# Altium schematic sheet fpga.SchDoc (part 2 of 3)
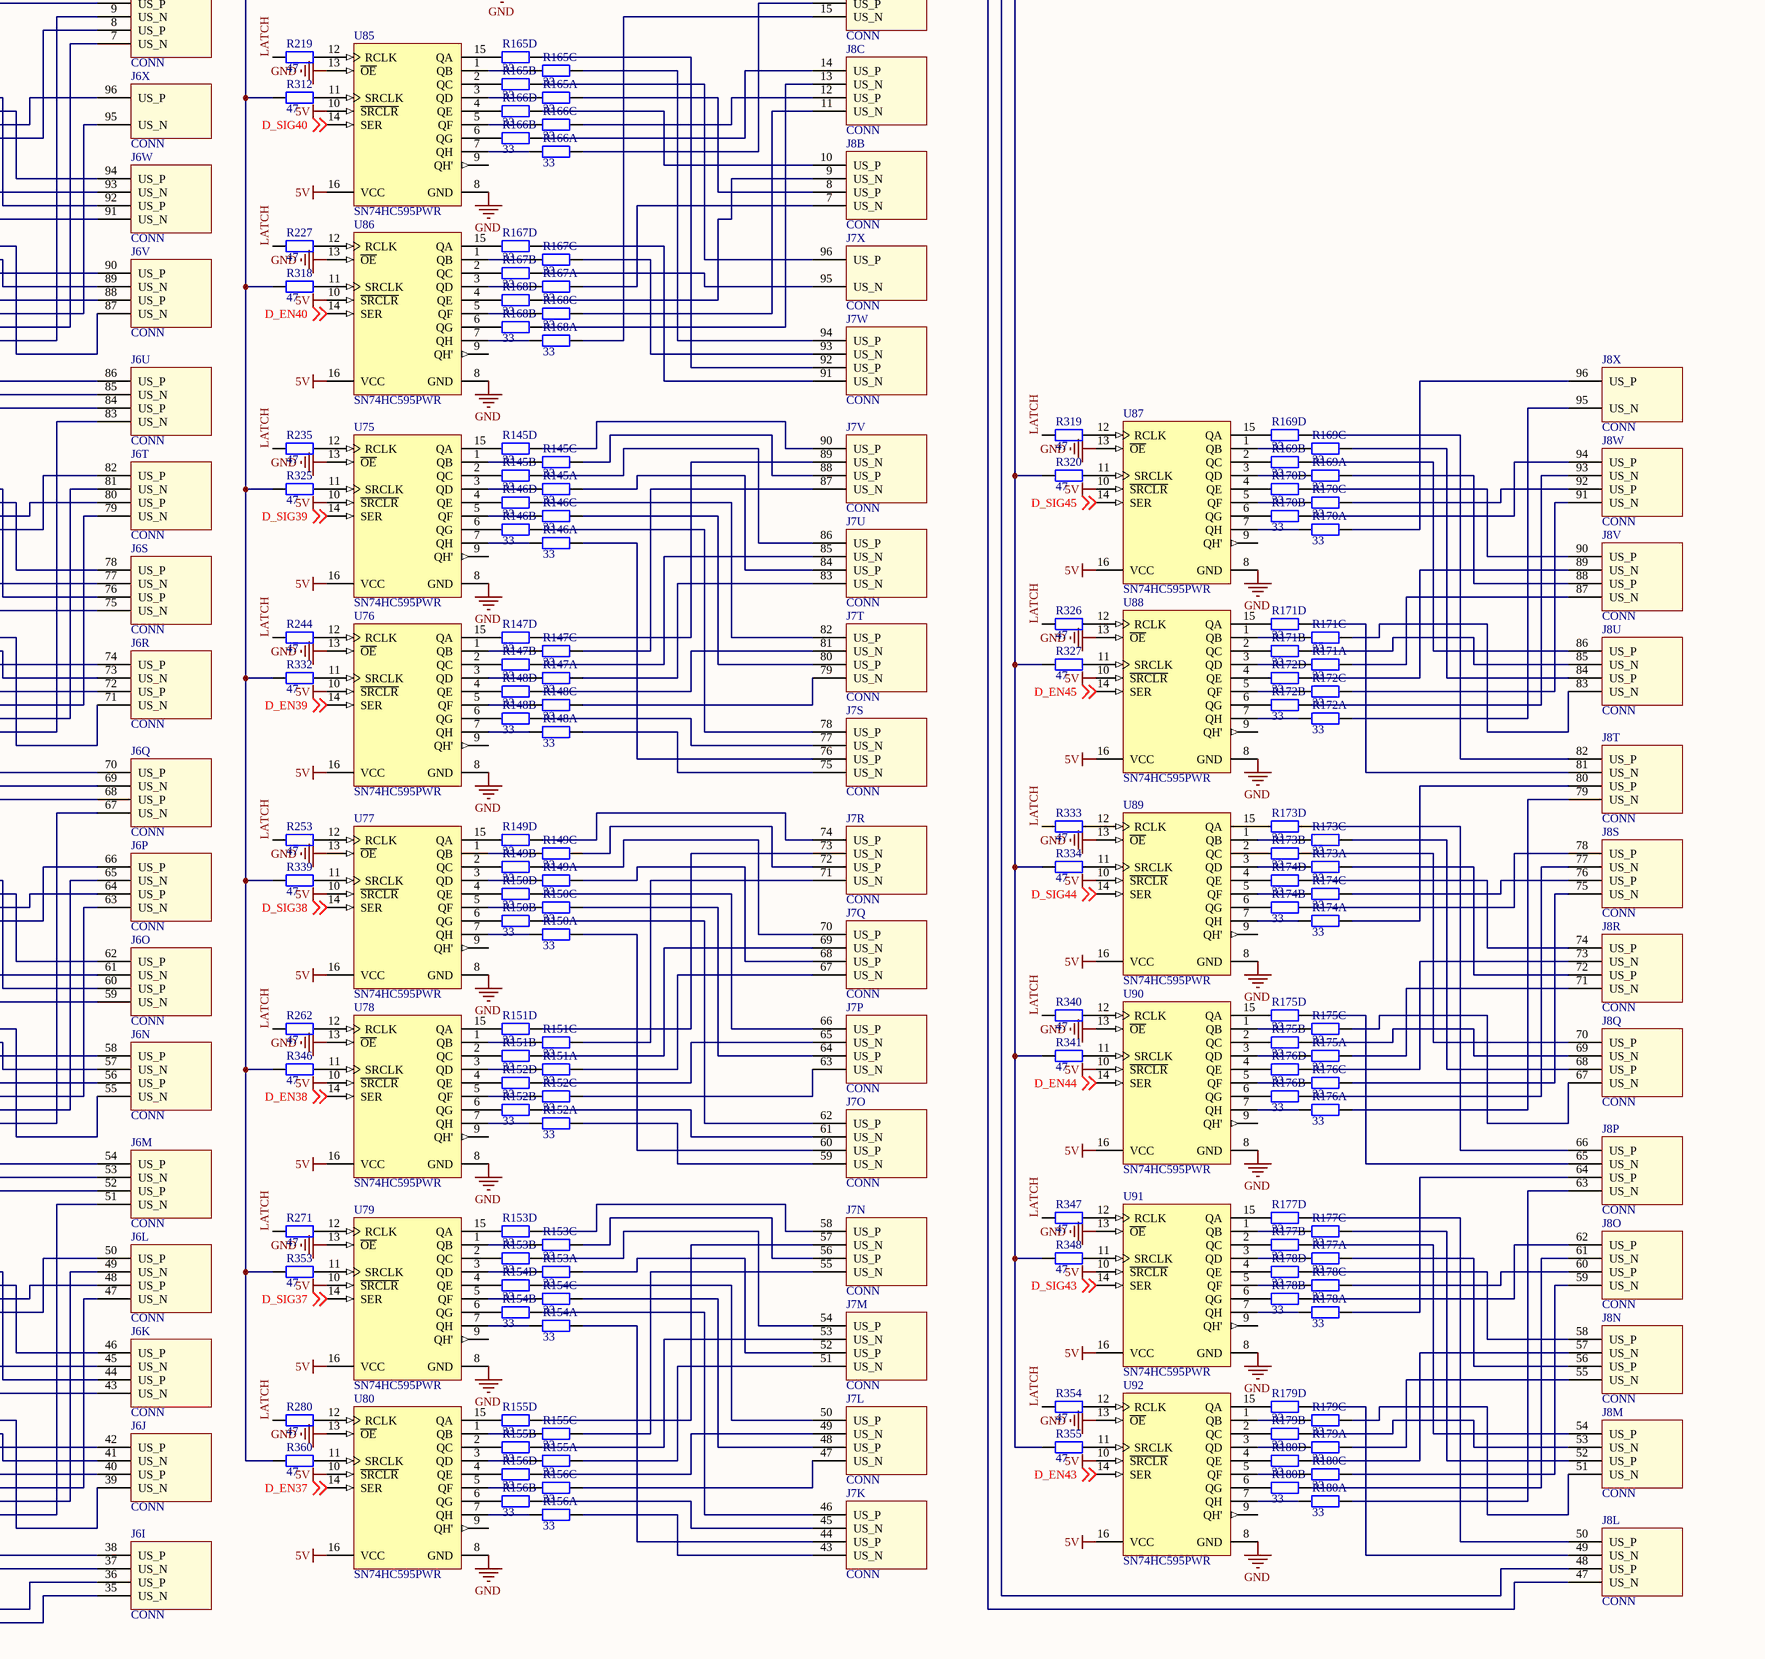
[diagram p6: fpga.SchDoc, bottom right]
## Nets
5V: C1.2 C2.2 C3.2 C4.2 C5.2 C6.2 C7.2 C8.2 C9.2 C10.2 C11.2 C12.2 C13.2 C14.2 C15.2 C16.2 C17.2 C18.2 C19.2 C20.2 C21.2 C22.2 C23.2 C24.2 C25.2 C26.2 C27.2 C28.2 C29.2 C30.2 C31.2 C32.2 C33.2 C34.2 C35.2 C36.2 C37.2 C38.2 C39.2 C40.2 C41.2 C42.2 C43.2 C44.2 C45.2 C46.2 C47.2 C48.2 C49.2 C50.2 C51.2 C52.2 C53.2 C54.2 C55.2 C56.2 C57.2 C58.2 C59.2 C60.2 C61.2 C62.2 C63.2 C64.2 C65.2 C66.2 C67.2 C68.2 C69.2 C70.2 C71.2 C72.2 C73.2 C74.2 C75.2 C76.2 C77.2 C78.2 C79.2 C80.2 C81.2 C82.2 C83.2 C84.2 C85.2 C86.2 C87.2 C88.2 C89.2 C90.2 J1.5(5V) J1.6(3V3) J2.5(5V) J2.6(3V3) J3.5(5V) J3.6(3V3) J4.5(5V) J4.6(3V3) J5.5(5V) J5.6(3V3) J6.5(5V) J6.6(3V3) J7.5(5V) J7.6(3V3) J8.5(5V) J8.6(3V3) U1.10(~{SRCLR}) U1.16(VCC) U2.10(~{SRCLR}) U2.16(VCC) U3.10(~{SRCLR}) U3.16(VCC) U4.10(~{SRCLR}) U4.16(VCC) U5.10(~{SRCLR}) U5.16(VCC) U6.10(~{SRCLR}) U6.16(VCC) U7.10(~{SRCLR}) U7.16(VCC) U8.10(~{SRCLR}) U8.16(VCC) U9.10(~{SRCLR}) U9.16(VCC) U10.10(~{SRCLR}) U10.16(VCC) U11.10(~{SRCLR}) U11.16(VCC) U12.10(~{SRCLR}) U12.16(VCC) U13.10(~{SRCLR}) U13.16(VCC) U14.10(~{SRCLR}) U14.16(VCC) U15.10(~{SRCLR}) U15.16(VCC) U16.10(~{SRCLR}) U16.16(VCC) U17.10(~{SRCLR}) U17.16(VCC) U18.10(~{SRCLR}) U18.16(VCC) U19.10(~{SRCLR}) U19.16(VCC) U20.10(~{SRCLR}) U20.16(VCC) U21.10(~{SRCLR}) U21.16(VCC) U22.10(~{SRCLR}) U22.16(VCC) U23.10(~{SRCLR}) U23.16(VCC) U24.10(~{SRCLR}) U24.16(VCC) U27.10(~{SRCLR}) U27.16(VCC) U28.10(~{SRCLR}) U28.16(VCC) U29.10(~{SRCLR}) U29.16(VCC) U30.10(~{SRCLR}) U30.16(VCC) U31.10(~{SRCLR}) U31.16(VCC) U32.10(~{SRCLR}) U32.16(VCC) U33.10(~{SRCLR}) U33.16(VCC) U34.10(~{SRCLR}) U34.16(VCC) U35.10(~{SRCLR}) U35.16(VCC) U36.10(~{SRCLR}) U36.16(VCC) U37.10(~{SRCLR}) U37.16(VCC) U38.10(~{SRCLR}) U38.16(VCC) U39.10(~{SRCLR}) U39.16(VCC) U40.10(~{SRCLR}) U40.16(VCC) U41.10(~{SRCLR}) U41.16(VCC) U42.10(~{SRCLR}) U42.16(VCC) U43.10(~{SRCLR}) U43.16(VCC) U44.10(~{SRCLR}) U44.16(VCC) U45.10(~{SRCLR}) U45.16(VCC) U46.10(~{SRCLR}) U46.16(VCC) U47.10(~{SRCLR}) U47.16(VCC) U48.10(~{SRCLR}) U48.16(VCC) U49.10(~{SRCLR}) U49.16(VCC) U50.10(~{SRCLR}) U50.16(VCC) U51.10(~{SRCLR}) U51.16(VCC) U52.10(~{SRCLR}) U52.16(VCC) U53.10(~{SRCLR}) U53.16(VCC) U54.10(~{SRCLR}) U54.16(VCC) U55.10(~{SRCLR}) U55.16(VCC) U56.10(~{SRCLR}) U56.16(VCC) U57.10(~{SRCLR}) U57.16(VCC) U58.10(~{SRCLR}) U58.16(VCC) U59.10(~{SRCLR}) U59.16(VCC) U60.10(~{SRCLR}) U60.16(VCC) U61.10(~{SRCLR}) U61.16(VCC) U62.10(~{SRCLR}) U62.16(VCC) U63.10(~{SRCLR}) U63.16(VCC) U64.10(~{SRCLR}) U64.16(VCC) U65.10(~{SRCLR}) U65.16(VCC) U66.10(~{SRCLR}) U66.16(VCC) U67.10(~{SRCLR}) U67.16(VCC) U68.10(~{SRCLR}) U68.16(VCC) U69.10(~{SRCLR}) U69.16(VCC) U70.10(~{SRCLR}) U70.16(VCC) U71.10(~{SRCLR}) U71.16(VCC) U72.10(~{SRCLR}) U72.16(VCC) U73.10(~{SRCLR}) U73.16(VCC) U74.10(~{SRCLR}) U74.16(VCC) U75.10(~{SRCLR}) U75.16(VCC) U76.10(~{SRCLR}) U76.16(VCC) U77.10(~{SRCLR}) U77.16(VCC) U78.10(~{SRCLR}) U78.16(VCC) U79.10(~{SRCLR}) U79.16(VCC) U80.10(~{SRCLR}) U80.16(VCC) U81.10(~{SRCLR}) U81.16(VCC) U82.10(~{SRCLR}) U82.16(VCC) U83.10(~{SRCLR}) U83.16(VCC) U84.10(~{SRCLR}) U84.16(VCC) U85.10(~{SRCLR}) U85.16(VCC) U86.10(~{SRCLR}) U86.16(VCC) U87.10(~{SRCLR}) U87.16(VCC) U88.10(~{SRCLR}) U88.16(VCC) U89.10(~{SRCLR}) U89.16(VCC) U90.10(~{SRCLR}) U90.16(VCC) U91.10(~{SRCLR}) U91.16(VCC) U92.10(~{SRCLR}) U92.16(VCC)
GND: C1.1 C2.1 C3.1 C4.1 C5.1 C6.1 C7.1 C8.1 C9.1 C10.1 C11.1 C12.1 C13.1 C14.1 C15.1 C16.1 C17.1 C18.1 C19.1 C20.1 C21.1 C22.1 C23.1 C24.1 C25.1 C26.1 C27.1 C28.1 C29.1 C30.1 C31.1 C32.1 C33.1 C34.1 C35.1 C36.1 C37.1 C38.1 C39.1 C40.1 C41.1 C42.1 C43.1 C44.1 C45.1 C46.1 C47.1 C48.1 C49.1 C50.1 C51.1 C52.1 C53.1 C54.1 C55.1 C56.1 C57.1 C58.1 C59.1 C60.1 C61.1 C62.1 C63.1 C64.1 C65.1 C66.1 C67.1 C68.1 C69.1 C70.1 C71.1 C72.1 C73.1 C74.1 C75.1 C76.1 C77.1 C78.1 C79.1 C80.1 C81.1 C82.1 C83.1 C84.1 C85.1 C86.1 C87.1 C88.1 C89.1 C90.1 C91.1 C92.1 C93.1 C94.1 C95.1 C96.1 C97.1 C98.1 J1.3(GND) J1.4(GND) J1.97(GND) J1.98(GND) J2.3(GND) J2.4(GND) J2.97(GND) J2.98(GND) J3.3(GND) J3.4(GND) J3.97(GND) J3.98(GND) J4.3(GND) J4.4(GND) J4.97(GND) J4.98(GND) J5.3(GND) J5.4(GND) J5.97(GND) J5.98(GND) J6.3(GND) J6.4(GND) J6.97(GND) J6.98(GND) J7.3(GND) J7.4(GND) J7.97(GND) J7.98(GND) J8.3(GND) J8.4(GND) J8.97(GND) J8.98(GND) U1.8(GND) U1.13(~{OE}) U2.8(GND) U2.13(~{OE}) U3.8(GND) U3.13(~{OE}) U4.8(GND) U4.13(~{OE}) U5.8(GND) U5.13(~{OE}) U6.8(GND) U6.13(~{OE}) U7.8(GND) U7.13(~{OE}) U8.8(GND) U8.13(~{OE}) U9.8(GND) U9.13(~{OE}) U10.8(GND) U10.13(~{OE}) U11.8(GND) U11.13(~{OE}) U12.8(GND) U12.13(~{OE}) U13.8(GND) U13.13(~{OE}) U14.8(GND) U14.13(~{OE}) U15.8(GND) U15.13(~{OE}) U16.8(GND) U16.13(~{OE}) U17.8(GND) U17.13(~{OE}) U18.8(GND) U18.13(~{OE}) U19.8(GND) U19.13(~{OE}) U20.8(GND) U20.13(~{OE}) U21.8(GND) U21.13(~{OE}) U22.8(GND) U22.13(~{OE}) U23.8(GND) U23.13(~{OE}) U24.8(GND) U24.13(~{OE}) U27.8(GND) U27.13(~{OE}) U28.8(GND) U28.13(~{OE}) U29.8(GND) U29.13(~{OE}) U30.8(GND) U30.13(~{OE}) U31.8(GND) U31.13(~{OE}) U32.8(GND) U32.13(~{OE}) U33.8(GND) U33.13(~{OE}) U34.8(GND) U34.13(~{OE}) U35.8(GND) U35.13(~{OE}) U36.8(GND) U36.13(~{OE}) U37.8(GND) U37.13(~{OE}) U38.8(GND) U38.13(~{OE}) U39.8(GND) U39.13(~{OE}) U40.8(GND) U40.13(~{OE}) U41.8(GND) U41.13(~{OE}) U42.8(GND) U42.13(~{OE}) U43.8(GND) U43.13(~{OE}) U44.8(GND) U44.13(~{OE}) U45.8(GND) U45.13(~{OE}) U46.8(GND) U46.13(~{OE}) U47.8(GND) U47.13(~{OE}) U48.8(GND) U48.13(~{OE}) U49.8(GND) U49.13(~{OE}) U50.8(GND) U50.13(~{OE}) U51.8(GND) U51.13(~{OE}) U52.8(GND) U52.13(~{OE}) U53.8(GND) U53.13(~{OE}) U54.8(GND) U54.13(~{OE}) U55.8(GND) U55.13(~{OE}) U56.8(GND) U56.13(~{OE}) U57.8(GND) U57.13(~{OE}) U58.8(GND) U58.13(~{OE}) U59.8(GND) U59.13(~{OE}) U60.8(GND) U60.13(~{OE}) U61.8(GND) U61.13(~{OE}) U62.8(GND) U62.13(~{OE}) U63.8(GND) U63.13(~{OE}) U64.8(GND) U64.13(~{OE}) U65.8(GND) U65.13(~{OE}) U66.8(GND) U66.13(~{OE}) U67.8(GND) U67.13(~{OE}) U68.8(GND) U68.13(~{OE}) U69.8(GND) U69.13(~{OE}) U70.8(GND) U70.13(~{OE}) U71.8(GND) U71.13(~{OE}) U72.8(GND) U72.13(~{OE}) U73.8(GND) U73.13(~{OE}) U74.8(GND) U74.13(~{OE}) U75.8(GND) U75.13(~{OE}) U76.8(GND) U76.13(~{OE}) U77.8(GND) U77.13(~{OE}) U78.8(GND) U78.13(~{OE}) U79.8(GND) U79.13(~{OE}) U80.8(GND) U80.13(~{OE}) U81.8(GND) U81.13(~{OE}) U82.8(GND) U82.13(~{OE}) U83.8(GND) U83.13(~{OE}) U84.8(GND) U84.13(~{OE}) U85.8(GND) U85.13(~{OE}) U86.8(GND) U86.13(~{OE}) U87.8(GND) U87.13(~{OE}) U88.8(GND) U88.13(~{OE}) U89.8(GND) U89.13(~{OE}) U90.8(GND) U90.13(~{OE}) U91.8(GND) U91.13(~{OE}) U92.8(GND) U92.13(~{OE})
VUS: C91.2 C92.2 C93.2 C94.2 C95.2 C96.2 C97.2 C98.2 J1.1(VUS) J1.2(VUS) J1.99(VUS) J1.100(VUS) J2.1(VUS) J2.2(VUS) J2.99(VUS) J2.100(VUS) J3.1(VUS) J3.2(VUS) J3.99(VUS) J3.100(VUS) J4.1(VUS) J4.2(VUS) J4.99(VUS) J4.100(VUS) J5.1(VUS) J5.2(VUS) J5.99(VUS) J5.100(VUS) J6.1(VUS) J6.2(VUS) J6.99(VUS) J6.100(VUS) J7.1(VUS) J7.2(VUS) J7.99(VUS) J7.100(VUS) J8.1(VUS) J8.2(VUS) J8.99(VUS) J8.100(VUS)
CLK1: R212.1 R220.1 R228.1 R236.1 R245.1 R254.1 R263.1 R272.1 R281.1 ; off-sheet CLK1
CLK2: R188.1 R196.1 R204.1 R237.1 R246.1 R255.1 R264.1 R273.1 R282.1 ; off-sheet CLK2
CLK3: R285.1 R291.1 R297.1 R303.1 R307.1 R313.1 R342.1 R349.1 R356.1 ; off-sheet CLK3
CLK4: R286.1 R292.1 R298.1 R304.1 R308.1 R314.1 R321.1 R328.1 R335.1 ; off-sheet CLK4
CLK5: R305.1 R309.1 R315.1 R322.1 R329.1 R336.1 R343.1 R350.1 R357.1 ; off-sheet CLK5
CLK6: R287.1 R293.1 R299.1 R323.1 R330.1 R337.1 R344.1 R351.1 R358.1 ; off-sheet CLK6
CLK7: R288.1 R294.1 R300.1 R306.1 R310.1 R316.1 R345.1 R352.1 R359.1 ; off-sheet CLK7
CLK8: R283.1 R289.1 R295.1 R301.1 R311.1 R317.1 R324.1 R331.1 R338.1 ; off-sheet CLK8
CLK9: R302.1 R312.1 R318.1 R325.1 R332.1 R339.1 R346.1 R353.1 R360.1 ; off-sheet CLK9
CLK10: R284.1 R290.1 R296.1 R320.1 R327.1 R334.1 R341.1 R348.1 R355.1 ; off-sheet CLK10
D_EN1: U23.14(SER) ; off-sheet D_EN1
D_EN2: U19.14(SER) ; off-sheet D_EN2
D_EN3: U15.14(SER) ; off-sheet D_EN3
D_EN4: U11.14(SER) ; off-sheet D_EN4
D_EN5: U7.14(SER) ; off-sheet D_EN5
D_EN6: U3.14(SER) ; off-sheet D_EN6
D_EN7: U24.14(SER) ; off-sheet D_EN7
D_EN8: U20.14(SER) ; off-sheet D_EN8
D_EN9: U16.14(SER) ; off-sheet D_EN9
D_EN10: U12.14(SER) ; off-sheet D_EN10
D_EN11: U8.14(SER) ; off-sheet D_EN11
D_EN12: U4.14(SER) ; off-sheet D_EN12
D_EN13: U38.14(SER) ; off-sheet D_EN13
D_EN14: U36.14(SER) ; off-sheet D_EN14
D_EN15: U34.14(SER) ; off-sheet D_EN15
D_EN16: U32.14(SER) ; off-sheet D_EN16
D_EN17: U30.14(SER) ; off-sheet D_EN17
D_EN18: U28.14(SER) ; off-sheet D_EN18
D_EN19: U50.14(SER) ; off-sheet D_EN19
D_EN20: U48.14(SER) ; off-sheet D_EN20
D_EN21: U46.14(SER) ; off-sheet D_EN21
D_EN22: U44.14(SER) ; off-sheet D_EN22
D_EN23: U42.14(SER) ; off-sheet D_EN23
D_EN24: U40.14(SER) ; off-sheet D_EN24
D_EN25: U62.14(SER) ; off-sheet D_EN25
D_EN26: U60.14(SER) ; off-sheet D_EN26
D_EN27: U58.14(SER) ; off-sheet D_EN27
D_EN28: U56.14(SER) ; off-sheet D_EN28
D_EN29: U54.14(SER) ; off-sheet D_EN29
D_EN30: U52.14(SER) ; off-sheet D_EN30
D_EN31: U70.14(SER) ; off-sheet D_EN31
D_EN32: U68.14(SER) ; off-sheet D_EN32
D_EN33: U66.14(SER) ; off-sheet D_EN33
D_EN34: U64.14(SER) ; off-sheet D_EN34
D_EN35: U74.14(SER) ; off-sheet D_EN35
D_EN36: U72.14(SER) ; off-sheet D_EN36
D_EN37: U80.14(SER) ; off-sheet D_EN37
D_EN38: U78.14(SER) ; off-sheet D_EN38
D_EN39: U76.14(SER) ; off-sheet D_EN39
D_EN40: U86.14(SER) ; off-sheet D_EN40
D_EN41: U84.14(SER) ; off-sheet D_EN41
D_EN42: U82.14(SER) ; off-sheet D_EN42
D_EN43: U92.14(SER) ; off-sheet D_EN43
D_EN44: U90.14(SER) ; off-sheet D_EN44
D_EN45: U88.14(SER) ; off-sheet D_EN45
D_SIG1: U21.14(SER) ; off-sheet D_SIG1
D_SIG2: U17.14(SER) ; off-sheet D_SIG2
D_SIG3: U13.14(SER) ; off-sheet D_SIG3
D_SIG4: U9.14(SER) ; off-sheet D_SIG4
D_SIG5: U5.14(SER) ; off-sheet D_SIG5
D_SIG6: U1.14(SER) ; off-sheet D_SIG6
D_SIG7: U22.14(SER) ; off-sheet D_SIG7
D_SIG8: U18.14(SER) ; off-sheet D_SIG8
D_SIG9: U14.14(SER) ; off-sheet D_SIG9
D_SIG10: U10.14(SER) ; off-sheet D_SIG10
D_SIG11: U6.14(SER) ; off-sheet D_SIG11
D_SIG12: U2.14(SER) ; off-sheet D_SIG12
D_SIG13: U37.14(SER) ; off-sheet D_SIG13
D_SIG14: U35.14(SER) ; off-sheet D_SIG14
D_SIG15: U33.14(SER) ; off-sheet D_SIG15
D_SIG16: U31.14(SER) ; off-sheet D_SIG16
D_SIG17: U29.14(SER) ; off-sheet D_SIG17
D_SIG18: U27.14(SER) ; off-sheet D_SIG18
D_SIG19: U49.14(SER) ; off-sheet D_SIG19
D_SIG20: U47.14(SER) ; off-sheet D_SIG20
D_SIG21: U45.14(SER) ; off-sheet D_SIG21
D_SIG22: U43.14(SER) ; off-sheet D_SIG22
D_SIG23: U41.14(SER) ; off-sheet D_SIG23
D_SIG24: U39.14(SER) ; off-sheet D_SIG24
D_SIG25: U61.14(SER) ; off-sheet D_SIG25
D_SIG26: U59.14(SER) ; off-sheet D_SIG26
D_SIG27: U57.14(SER) ; off-sheet D_SIG27
D_SIG28: U55.14(SER) ; off-sheet D_SIG28
D_SIG29: U53.14(SER) ; off-sheet D_SIG29
D_SIG30: U51.14(SER) ; off-sheet D_SIG30
D_SIG31: U69.14(SER) ; off-sheet D_SIG31
D_SIG32: U67.14(SER) ; off-sheet D_SIG32
D_SIG33: U65.14(SER) ; off-sheet D_SIG33
D_SIG34: U63.14(SER) ; off-sheet D_SIG34
D_SIG35: U73.14(SER) ; off-sheet D_SIG35
D_SIG36: U71.14(SER) ; off-sheet D_SIG36
D_SIG37: U79.14(SER) ; off-sheet D_SIG37
D_SIG38: U77.14(SER) ; off-sheet D_SIG38
D_SIG39: U75.14(SER) ; off-sheet D_SIG39
D_SIG40: U85.14(SER) ; off-sheet D_SIG40
D_SIG41: U83.14(SER) ; off-sheet D_SIG41
D_SIG42: U81.14(SER) ; off-sheet D_SIG42
D_SIG43: U91.14(SER) ; off-sheet D_SIG43
D_SIG44: U89.14(SER) ; off-sheet D_SIG44
D_SIG45: U87.14(SER) ; off-sheet D_SIG45
LATCH: R181.1 R182.1 R183.1 R184.1 R185.1 R186.1 R187.1 R189.1 R190.1 R191.1 R192.1 R193.1 R194.1 R195.1 R197.1 R198.1 R199.1 R200.1 R201.1 R202.1 R203.1 R205.1 R206.1 R207.1 R208.1 R209.1 R210.1 R211.1 R213.1 R214.1 R215.1 R216.1 R217.1 R218.1 R219.1 R221.1 R222.1 R223.1 R224.1 R225.1 R226.1 R227.1 R229.1 R230.1 R231.1 R232.1 R233.1 R234.1 R235.1 R238.1 R239.1 R240.1 R241.1 R242.1 R243.1 R244.1 R247.1 R248.1 R249.1 R250.1 R251.1 R252.1 R253.1 R256.1 R257.1 R258.1 R259.1 R260.1 R261.1 R262.1 R265.1 R266.1 R267.1 R268.1 R269.1 R270.1 R271.1 R274.1 R275.1 R276.1 R277.1 R278.1 R279.1 R280.1 R319.1 R326.1 R333.1 R340.1 R347.1 R354.1 ; off-sheet LATCH
NetJ1_7: J1.7(US_N) R47.8
NetJ1_8: J1.8(US_P) R43.8
NetJ1_9: J1.9(US_N) R47.7
NetJ1_10: J1.10(US_P) R43.7
NetJ1_11: J1.11(US_N) R47.6
NetJ1_12: J1.12(US_P) R43.6
NetJ1_13: J1.13(US_N) R47.5
NetJ1_14: J1.14(US_P) R43.5
NetJ1_15: J1.15(US_N) R45.8
NetJ1_16: J1.16(US_P) R41.8
NetJ1_17: J1.17(US_N) R45.7
NetJ1_18: J1.18(US_P) R41.7
NetJ1_19: J1.19(US_N) R45.6
NetJ1_20: J1.20(US_P) R41.6
NetJ1_21: J1.21(US_N) R45.5
NetJ1_22: J1.22(US_P) R41.5
NetJ1_23: J1.23(US_N) R39.8
NetJ1_24: J1.24(US_P) R35.8
NetJ1_25: J1.25(US_N) R39.7
NetJ1_26: J1.26(US_P) R35.7
NetJ1_27: J1.27(US_N) R39.6
NetJ1_28: J1.28(US_P) R35.6
NetJ1_29: J1.29(US_N) R39.5
NetJ1_30: J1.30(US_P) R35.5
NetJ1_31: J1.31(US_N) R37.8
NetJ1_32: J1.32(US_P) R33.8
NetJ1_33: J1.33(US_N) R37.7
NetJ1_34: J1.34(US_P) R33.7
NetJ1_35: J1.35(US_N) R37.6
NetJ1_36: J1.36(US_P) R33.6
NetJ1_37: J1.37(US_N) R37.5
NetJ1_38: J1.38(US_P) R33.5
NetJ1_39: J1.39(US_N) R31.8
NetJ1_40: J1.40(US_P) R27.8
NetJ1_41: J1.41(US_N) R31.7
NetJ1_42: J1.42(US_P) R27.7
NetJ1_43: J1.43(US_N) R31.6
NetJ1_44: J1.44(US_P) R27.6
NetJ1_45: J1.45(US_N) R31.5
NetJ1_46: J1.46(US_P) R27.5
NetJ1_47: J1.47(US_N) R29.8
NetJ1_48: J1.48(US_P) R25.8
NetJ1_49: J1.49(US_N) R29.7
NetJ1_50: J1.50(US_P) R25.7
NetJ1_51: J1.51(US_N) R29.6
NetJ1_52: J1.52(US_P) R25.6
NetJ1_53: J1.53(US_N) R29.5
NetJ1_54: J1.54(US_P) R25.5
NetJ1_55: J1.55(US_N) R23.8
NetJ1_56: J1.56(US_P) R19.8
NetJ1_57: J1.57(US_N) R23.7
NetJ1_58: J1.58(US_P) R19.7
NetJ1_59: J1.59(US_N) R23.6
NetJ1_60: J1.60(US_P) R19.6
NetJ1_61: J1.61(US_N) R23.5
NetJ1_62: J1.62(US_P) R19.5
NetJ1_63: J1.63(US_N) R21.8
NetJ1_64: J1.64(US_P) R17.8
NetJ1_65: J1.65(US_N) R21.7
NetJ1_66: J1.66(US_P) R17.7
NetJ1_67: J1.67(US_N) R21.6
NetJ1_68: J1.68(US_P) R17.6
NetJ1_69: J1.69(US_N) R21.5
NetJ1_70: J1.70(US_P) R17.5
NetJ1_71: J1.71(US_N) R15.8
NetJ1_72: J1.72(US_P) R11.8
NetJ1_73: J1.73(US_N) R15.7
NetJ1_74: J1.74(US_P) R11.7
NetJ1_75: J1.75(US_N) R15.6
NetJ1_76: J1.76(US_P) R11.6
NetJ1_77: J1.77(US_N) R15.5
NetJ1_78: J1.78(US_P) R11.5
NetJ1_79: J1.79(US_N) R13.8
NetJ1_80: J1.80(US_P) R9.8
NetJ1_81: J1.81(US_N) R13.7
NetJ1_82: J1.82(US_P) R9.7
NetJ1_83: J1.83(US_N) R13.6
NetJ1_84: J1.84(US_P) R9.6
NetJ1_85: J1.85(US_N) R13.5
NetJ1_86: J1.86(US_P) R9.5
NetJ1_87: J1.87(US_N) R7.8
NetJ1_88: J1.88(US_P) R3.8
NetJ1_89: J1.89(US_N) R7.7
NetJ1_90: J1.90(US_P) R3.7
NetJ1_91: J1.91(US_N) R7.6
NetJ1_92: J1.92(US_P) R3.6
NetJ1_93: J1.93(US_N) R7.5
NetJ1_94: J1.94(US_P) R3.5
NetJ1_95: J1.95(US_N) R5.8
NetJ1_96: J1.96(US_P) R1.8
NetJ2_7: J2.7(US_N) R5.7
NetJ2_8: J2.8(US_P) R1.7
NetJ2_9: J2.9(US_N) R5.6
NetJ2_10: J2.10(US_P) R1.6
NetJ2_11: J2.11(US_N) R5.5
NetJ2_12: J2.12(US_P) R1.5
NetJ2_13: J2.13(US_N) R46.5
NetJ2_14: J2.14(US_P) R42.5
NetJ2_15: J2.15(US_N) R46.6
NetJ2_16: J2.16(US_P) R42.6
NetJ2_17: J2.17(US_N) R46.7
NetJ2_18: J2.18(US_P) R42.7
NetJ2_19: J2.19(US_N) R46.8
NetJ2_20: J2.20(US_P) R42.8
NetJ2_21: J2.21(US_N) R48.5
NetJ2_22: J2.22(US_P) R44.5
NetJ2_23: J2.23(US_N) R48.6
NetJ2_24: J2.24(US_P) R44.6
NetJ2_25: J2.25(US_N) R48.7
NetJ2_26: J2.26(US_P) R44.7
NetJ2_27: J2.27(US_N) R48.8
NetJ2_28: J2.28(US_P) R44.8
NetJ2_29: J2.29(US_N) R38.5
NetJ2_30: J2.30(US_P) R34.5
NetJ2_31: J2.31(US_N) R38.6
NetJ2_32: J2.32(US_P) R34.6
NetJ2_33: J2.33(US_N) R38.7
NetJ2_34: J2.34(US_P) R34.7
NetJ2_35: J2.35(US_N) R38.8
NetJ2_36: J2.36(US_P) R34.8
NetJ2_37: J2.37(US_N) R40.5
NetJ2_38: J2.38(US_P) R36.5
NetJ2_39: J2.39(US_N) R40.6
NetJ2_40: J2.40(US_P) R36.6
NetJ2_41: J2.41(US_N) R40.7
NetJ2_42: J2.42(US_P) R36.7
NetJ2_43: J2.43(US_N) R40.8
NetJ2_44: J2.44(US_P) R36.8
NetJ2_45: J2.45(US_N) R30.5
NetJ2_46: J2.46(US_P) R26.5
NetJ2_47: J2.47(US_N) R30.6
NetJ2_48: J2.48(US_P) R26.6
NetJ2_49: J2.49(US_N) R30.7
NetJ2_50: J2.50(US_P) R26.7
NetJ2_51: J2.51(US_N) R30.8
NetJ2_52: J2.52(US_P) R26.8
NetJ2_53: J2.53(US_N) R32.5
NetJ2_54: J2.54(US_P) R28.5
NetJ2_55: J2.55(US_N) R32.6
NetJ2_56: J2.56(US_P) R28.6
NetJ2_57: J2.57(US_N) R32.7
NetJ2_58: J2.58(US_P) R28.7
NetJ2_59: J2.59(US_N) R32.8
NetJ2_60: J2.60(US_P) R28.8
NetJ2_61: J2.61(US_N) R22.5
NetJ2_62: J2.62(US_P) R18.5
NetJ2_63: J2.63(US_N) R22.6
NetJ2_64: J2.64(US_P) R18.6
NetJ2_65: J2.65(US_N) R22.7
NetJ2_66: J2.66(US_P) R18.7
NetJ2_67: J2.67(US_N) R22.8
NetJ2_68: J2.68(US_P) R18.8
NetJ2_69: J2.69(US_N) R24.5
NetJ2_70: J2.70(US_P) R20.5
NetJ2_71: J2.71(US_N) R24.6
NetJ2_72: J2.72(US_P) R20.6
NetJ2_73: J2.73(US_N) R24.7
NetJ2_74: J2.74(US_P) R20.7
NetJ2_75: J2.75(US_N) R24.8
NetJ2_76: J2.76(US_P) R20.8
NetJ2_77: J2.77(US_N) R14.5
NetJ2_78: J2.78(US_P) R10.5
NetJ2_79: J2.79(US_N) R14.6
NetJ2_80: J2.80(US_P) R10.6
NetJ2_81: J2.81(US_N) R14.7
NetJ2_82: J2.82(US_P) R10.7
NetJ2_83: J2.83(US_N) R14.8
NetJ2_84: J2.84(US_P) R10.8
NetJ2_85: J2.85(US_N) R16.5
NetJ2_86: J2.86(US_P) R12.5
NetJ2_87: J2.87(US_N) R16.6
NetJ2_88: J2.88(US_P) R12.6
NetJ2_89: J2.89(US_N) R16.7
NetJ2_90: J2.90(US_P) R12.7
NetJ2_91: J2.91(US_N) R16.8
NetJ2_92: J2.92(US_P) R12.8
NetJ2_93: J2.93(US_N) R6.5
NetJ2_94: J2.94(US_P) R2.5
NetJ2_95: J2.95(US_N) R6.6
NetJ2_96: J2.96(US_P) R2.6
NetJ3_7: J3.7(US_N) R6.7
NetJ3_8: J3.8(US_P) R2.7
NetJ3_9: J3.9(US_N) R6.8
NetJ3_10: J3.10(US_P) R2.8
NetJ3_11: J3.11(US_N) R8.5
NetJ3_12: J3.12(US_P) R4.5
NetJ3_13: J3.13(US_N) R8.6
NetJ3_14: J3.14(US_P) R4.6
NetJ3_15: J3.15(US_N) R8.7
NetJ3_16: J3.16(US_P) R4.7
NetJ3_17: J3.17(US_N) R8.8
NetJ3_18: J3.18(US_P) R4.8
NetJ3_19: J3.19(US_N) R72.8
NetJ3_20: J3.20(US_P) R70.8
NetJ3_21: J3.21(US_N) R72.7
NetJ3_22: J3.22(US_P) R70.7
NetJ3_23: J3.23(US_N) R72.6
NetJ3_24: J3.24(US_P) R70.6
NetJ3_25: J3.25(US_N) R72.5
NetJ3_26: J3.26(US_P) R70.5
NetJ3_27: J3.27(US_N) R71.8
NetJ3_28: J3.28(US_P) R69.8
NetJ3_29: J3.29(US_N) R71.7
NetJ3_30: J3.30(US_P) R69.7
NetJ3_31: J3.31(US_N) R71.6
NetJ3_32: J3.32(US_P) R69.6
NetJ3_33: J3.33(US_N) R71.5
NetJ3_34: J3.34(US_P) R69.5
NetJ3_35: J3.35(US_N) R68.8
NetJ3_36: J3.36(US_P) R66.8
NetJ3_37: J3.37(US_N) R68.7
NetJ3_38: J3.38(US_P) R66.7
NetJ3_39: J3.39(US_N) R68.6
NetJ3_40: J3.40(US_P) R66.6
NetJ3_41: J3.41(US_N) R68.5
NetJ3_42: J3.42(US_P) R66.5
NetJ3_43: J3.43(US_N) R67.8
NetJ3_44: J3.44(US_P) R65.8
NetJ3_45: J3.45(US_N) R67.7
NetJ3_46: J3.46(US_P) R65.7
NetJ3_47: J3.47(US_N) R67.6
NetJ3_48: J3.48(US_P) R65.6
NetJ3_49: J3.49(US_N) R67.5
NetJ3_50: J3.50(US_P) R65.5
NetJ3_51: J3.51(US_N) R64.8
NetJ3_52: J3.52(US_P) R62.8
NetJ3_53: J3.53(US_N) R64.7
NetJ3_54: J3.54(US_P) R62.7
NetJ3_55: J3.55(US_N) R64.6
NetJ3_56: J3.56(US_P) R62.6
NetJ3_57: J3.57(US_N) R64.5
NetJ3_58: J3.58(US_P) R62.5
NetJ3_59: J3.59(US_N) R63.8
NetJ3_60: J3.60(US_P) R61.8
NetJ3_61: J3.61(US_N) R63.7
NetJ3_62: J3.62(US_P) R61.7
NetJ3_63: J3.63(US_N) R63.6
NetJ3_64: J3.64(US_P) R61.6
NetJ3_65: J3.65(US_N) R63.5
NetJ3_66: J3.66(US_P) R61.5
NetJ3_67: J3.67(US_N) R60.8
NetJ3_68: J3.68(US_P) R58.8
NetJ3_69: J3.69(US_N) R60.7
NetJ3_70: J3.70(US_P) R58.7
NetJ3_71: J3.71(US_N) R60.6
NetJ3_72: J3.72(US_P) R58.6
NetJ3_73: J3.73(US_N) R60.5
NetJ3_74: J3.74(US_P) R58.5
NetJ3_75: J3.75(US_N) R59.8
NetJ3_76: J3.76(US_P) R57.8
NetJ3_77: J3.77(US_N) R59.7
NetJ3_78: J3.78(US_P) R57.7
NetJ3_79: J3.79(US_N) R59.6
NetJ3_80: J3.80(US_P) R57.6
NetJ3_81: J3.81(US_N) R59.5
NetJ3_82: J3.82(US_P) R57.5
NetJ3_83: J3.83(US_N) R56.8
NetJ3_84: J3.84(US_P) R54.8
NetJ3_85: J3.85(US_N) R56.7
NetJ3_86: J3.86(US_P) R54.7
NetJ3_87: J3.87(US_N) R56.6
NetJ3_88: J3.88(US_P) R54.6
NetJ3_89: J3.89(US_N) R56.5
NetJ3_90: J3.90(US_P) R54.5
NetJ3_91: J3.91(US_N) R55.8
NetJ3_92: J3.92(US_P) R53.8
NetJ3_93: J3.93(US_N) R55.7
NetJ3_94: J3.94(US_P) R53.7
NetJ3_95: J3.95(US_N) R55.6
NetJ3_96: J3.96(US_P) R53.6
NetJ4_7: J4.7(US_N) R55.5
NetJ4_8: J4.8(US_P) R53.5
NetJ4_9: J4.9(US_N) R51.5
NetJ4_10: J4.10(US_P) R49.5
NetJ4_11: J4.11(US_N) R51.6
NetJ4_12: J4.12(US_P) R49.6
NetJ4_13: J4.13(US_N) R51.7
NetJ4_14: J4.14(US_P) R49.7
NetJ4_15: J4.15(US_N) R51.8
NetJ4_16: J4.16(US_P) R49.8
NetJ4_17: J4.17(US_N) R52.5
NetJ4_18: J4.18(US_P) R50.5
NetJ4_19: J4.19(US_N) R52.6
NetJ4_20: J4.20(US_P) R50.6
NetJ4_21: J4.21(US_N) R52.7
NetJ4_22: J4.22(US_P) R50.7
NetJ4_23: J4.23(US_N) R52.8
NetJ4_24: J4.24(US_P) R50.8
NetJ4_25: J4.25(US_N) R95.5
NetJ4_26: J4.26(US_P) R93.5
NetJ4_27: J4.27(US_N) R95.6
NetJ4_28: J4.28(US_P) R93.6
NetJ4_29: J4.29(US_N) R95.7
NetJ4_30: J4.30(US_P) R93.7
NetJ4_31: J4.31(US_N) R95.8
NetJ4_32: J4.32(US_P) R93.8
NetJ4_33: J4.33(US_N) R96.5
NetJ4_34: J4.34(US_P) R94.5
NetJ4_35: J4.35(US_N) R96.6
NetJ4_36: J4.36(US_P) R94.6
NetJ4_37: J4.37(US_N) R96.7
NetJ4_38: J4.38(US_P) R94.7
NetJ4_39: J4.39(US_N) R96.8
NetJ4_40: J4.40(US_P) R94.8
NetJ4_41: J4.41(US_N) R91.5
NetJ4_42: J4.42(US_P) R89.5
NetJ4_43: J4.43(US_N) R91.6
NetJ4_44: J4.44(US_P) R89.6
NetJ4_45: J4.45(US_N) R91.7
NetJ4_46: J4.46(US_P) R89.7
NetJ4_47: J4.47(US_N) R91.8
NetJ4_48: J4.48(US_P) R89.8
NetJ4_49: J4.49(US_N) R92.5
NetJ4_50: J4.50(US_P) R90.5
NetJ4_51: J4.51(US_N) R92.6
NetJ4_52: J4.52(US_P) R90.6
NetJ4_53: J4.53(US_N) R92.7
NetJ4_54: J4.54(US_P) R90.7
NetJ4_55: J4.55(US_N) R92.8
NetJ4_56: J4.56(US_P) R90.8
NetJ4_57: J4.57(US_N) R87.5
NetJ4_58: J4.58(US_P) R85.5
NetJ4_59: J4.59(US_N) R87.6
NetJ4_60: J4.60(US_P) R85.6
NetJ4_61: J4.61(US_N) R87.7
NetJ4_62: J4.62(US_P) R85.7
NetJ4_63: J4.63(US_N) R87.8
NetJ4_64: J4.64(US_P) R85.8
NetJ4_65: J4.65(US_N) R88.5
NetJ4_66: J4.66(US_P) R86.5
NetJ4_67: J4.67(US_N) R88.6
NetJ4_68: J4.68(US_P) R86.6
NetJ4_69: J4.69(US_N) R88.7
NetJ4_70: J4.70(US_P) R86.7
NetJ4_71: J4.71(US_N) R88.8
NetJ4_72: J4.72(US_P) R86.8
NetJ4_73: J4.73(US_N) R83.5
NetJ4_74: J4.74(US_P) R81.5
NetJ4_75: J4.75(US_N) R83.6
NetJ4_76: J4.76(US_P) R81.6
NetJ4_77: J4.77(US_N) R83.7
NetJ4_78: J4.78(US_P) R81.7
NetJ4_79: J4.79(US_N) R83.8
NetJ4_80: J4.80(US_P) R81.8
NetJ4_81: J4.81(US_N) R84.5
NetJ4_82: J4.82(US_P) R82.5
NetJ4_83: J4.83(US_N) R84.6
NetJ4_84: J4.84(US_P) R82.6
NetJ4_85: J4.85(US_N) R84.7
NetJ4_86: J4.86(US_P) R82.7
NetJ4_87: J4.87(US_N) R84.8
NetJ4_88: J4.88(US_P) R82.8
NetJ4_89: J4.89(US_N) R79.5
NetJ4_90: J4.90(US_P) R77.5
NetJ4_91: J4.91(US_N) R79.6
NetJ4_92: J4.92(US_P) R77.6
NetJ4_93: J4.93(US_N) R79.7
NetJ4_94: J4.94(US_P) R77.7
NetJ4_95: J4.95(US_N) R79.8
NetJ4_96: J4.96(US_P) R77.8
NetJ5_7: J5.7(US_N) R80.5
NetJ5_8: J5.8(US_P) R78.5
NetJ5_9: J5.9(US_N) R80.6
NetJ5_10: J5.10(US_P) R78.6
NetJ5_11: J5.11(US_N) R80.7
NetJ5_12: J5.12(US_P) R78.7
NetJ5_13: J5.13(US_N) R80.8
NetJ5_14: J5.14(US_P) R78.8
NetJ5_15: J5.15(US_N) R76.8
NetJ5_16: J5.16(US_P) R74.8
NetJ5_17: J5.17(US_N) R76.7
NetJ5_18: J5.18(US_P) R74.7
NetJ5_19: J5.19(US_N) R76.6
NetJ5_20: J5.20(US_P) R74.6
NetJ5_21: J5.21(US_N) R76.5
NetJ5_22: J5.22(US_P) R74.5
NetJ5_23: J5.23(US_N) R75.8
NetJ5_24: J5.24(US_P) R73.8
NetJ5_25: J5.25(US_N) R75.7
NetJ5_26: J5.26(US_P) R73.7